# EasyEDA Pro project AgOopenHardwareMicro.eprj, board PCB_AIO v4.5 Micro AMP 2024-02-05 (continued)
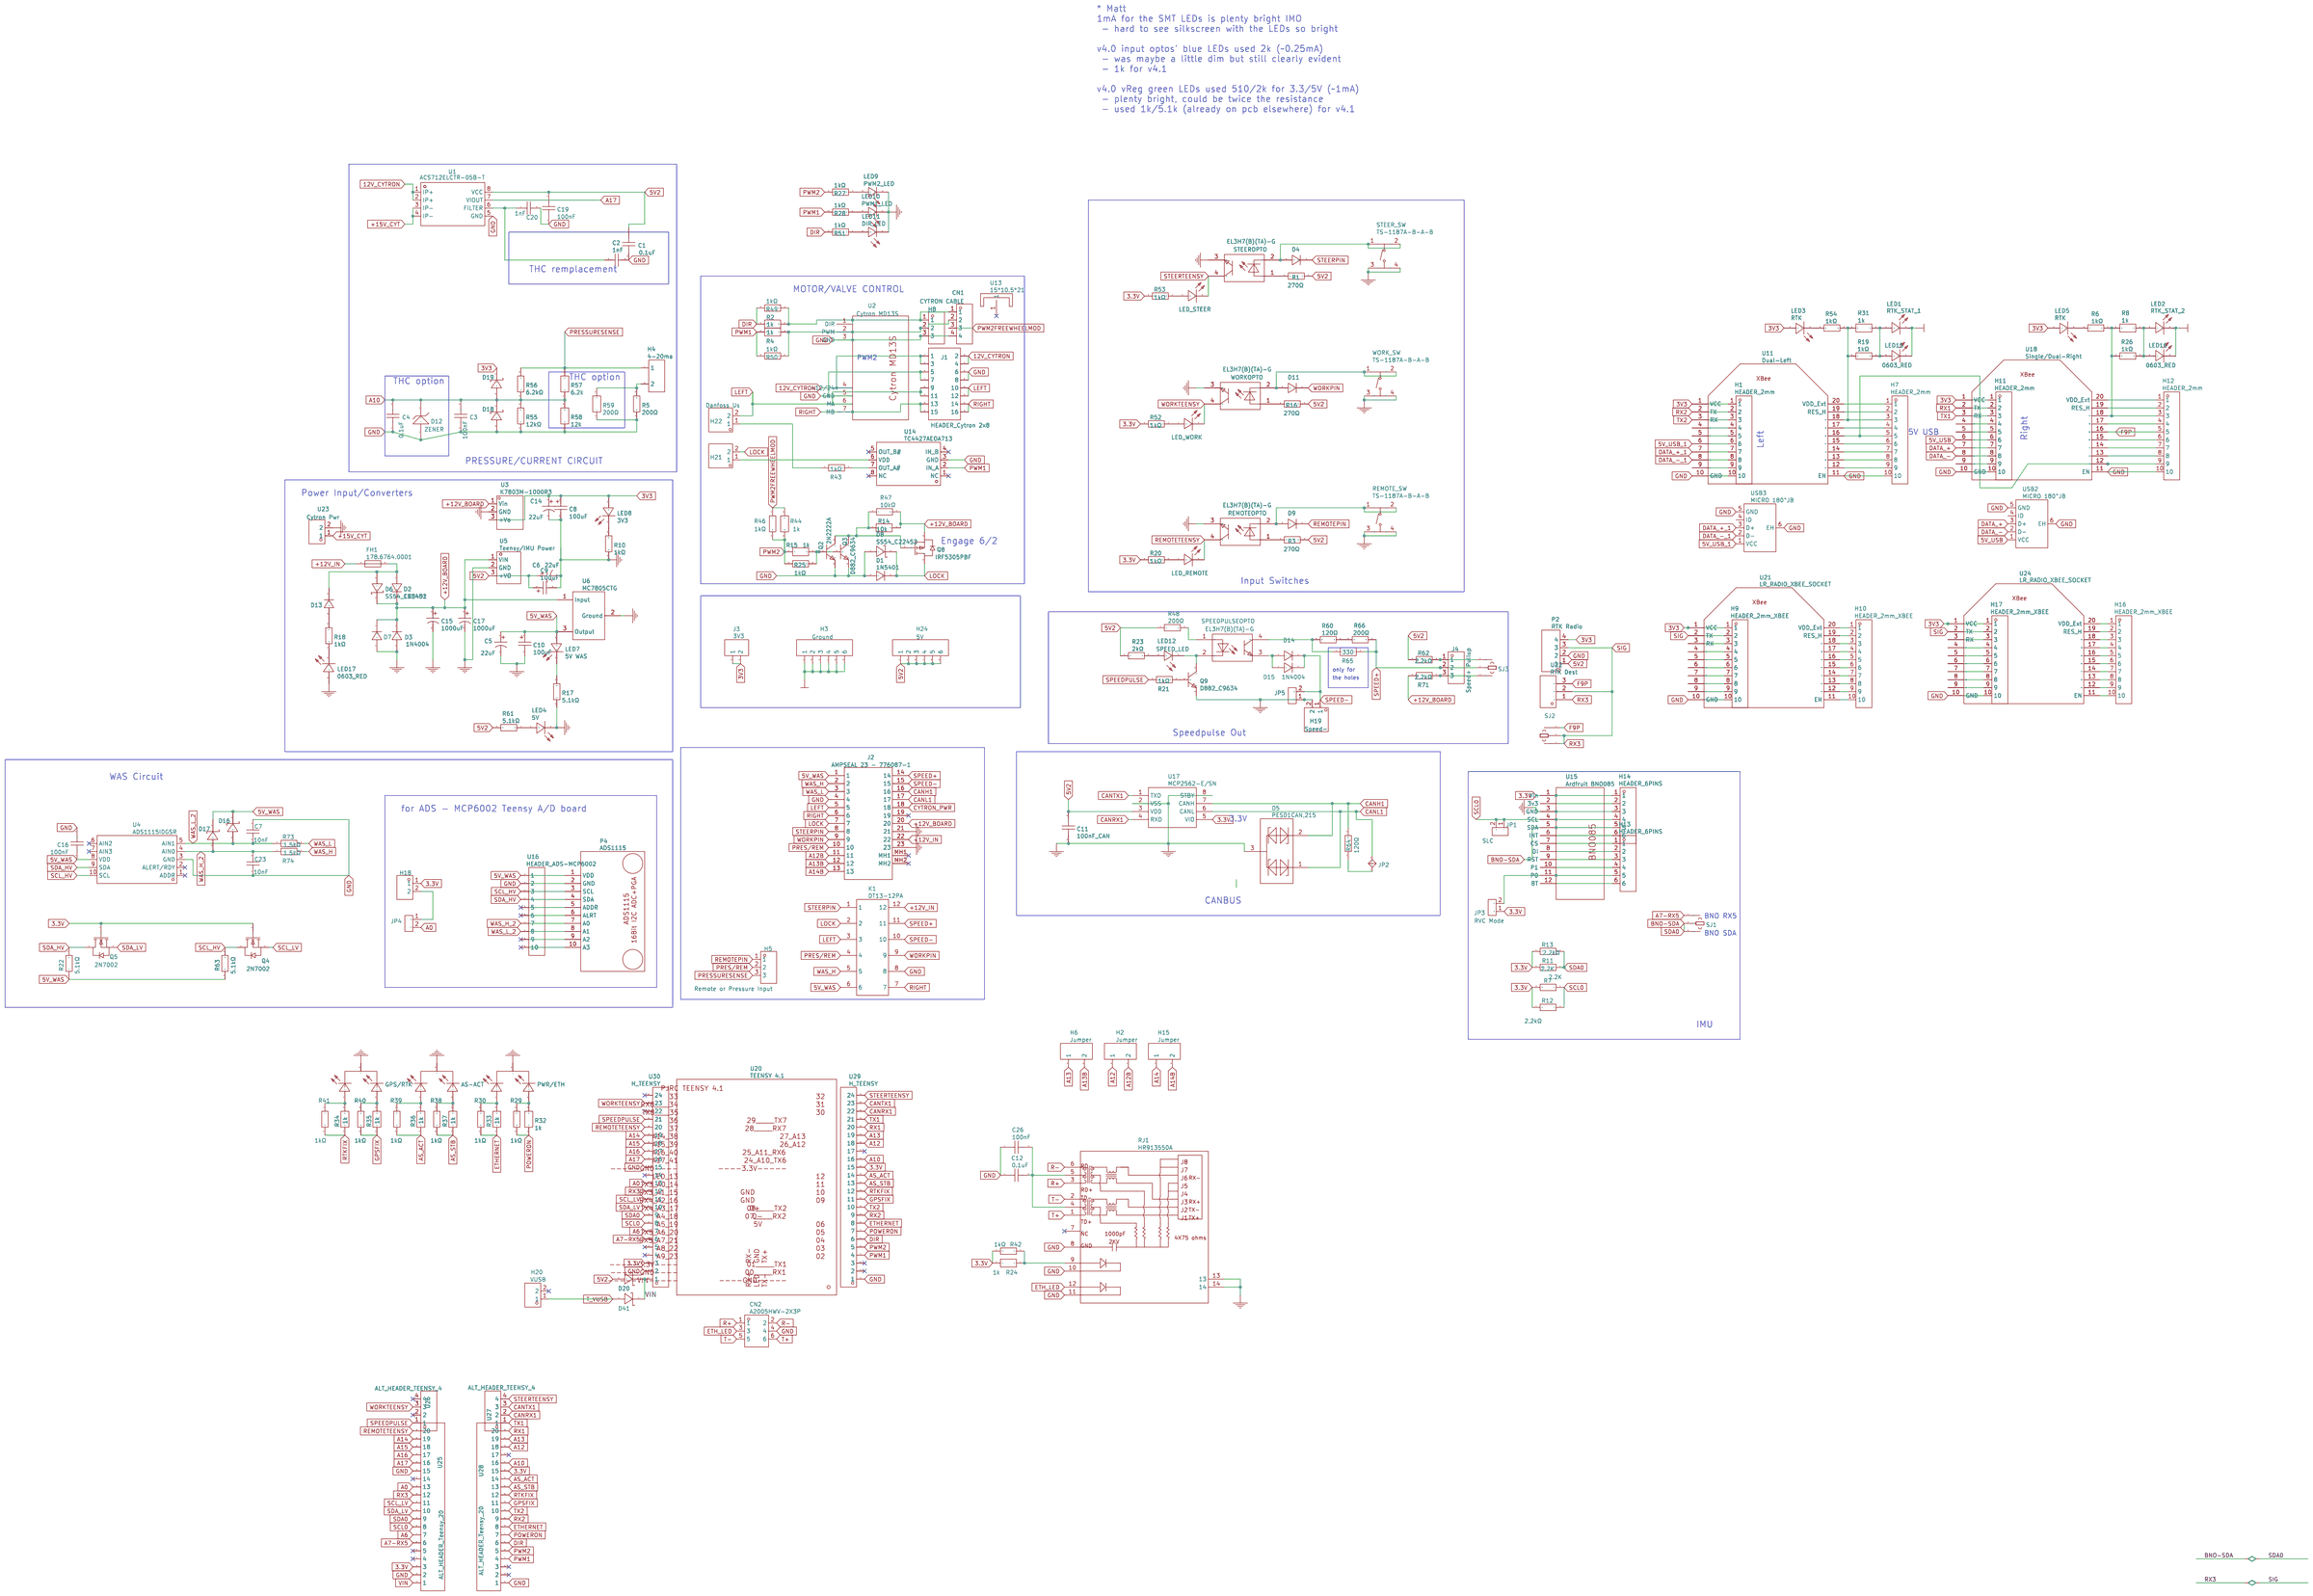
[diagram p0: schematic sheet]
## Footprints (pads in the part's own frame, mm; a bottom-side part is the same pattern mirrored in y, then rotated) (continued)
footprint_c888
  rect 1.8x1.6 hole 1.02: 1(-6.35,0)
  round 1.6 hole 1.02: 2(-3.81,0) 3(-1.27,0) 4(1.27,0) 5(3.81,0) 6(6.35,0)
footprint_cc47
  rect 1.931x1.931 smd: 1(1.27,0) 2(-1.27,0)
footprint_dc35
  rect 1.133x1.377 smd: 1(-0.966,0) 2(0.966,0)
footprint_df55
  rect 1.25x0.7 smd: 1(1,-0.95) 2(1,0.95) 3(-1,0)
footprint_dfc0
  rect 1.8x1.8 hole 1.2: 1(-6.35,0)
  round 1.8 hole 1.2: 2(-3.81,0) 3(-1.27,0) 4(1.27,0) 5(3.81,0) 6(6.35,0)
footprint_e2a5
  rect 1.208x1.701 smd: 1(-1.478,0) 2(1.479,0)
footprint_e36f
  rect 1.931x1.931 smd: 1(1.27,0) 2(-1.27,0) 3(-3.81,0)
footprint_eabb
  round 2 hole 1.5: 1(0,0)
footprint_eaf4
  rect 2.5x2 hole 1.3: 1(0,2.54)
  oval 2.5x2 hole 1.3: 2(0,0) 3(0,-2.54)
footprint_eb8a
  rect 0.806x0.864 smd: 1(-0.753,0) 2(0.753,0)
footprint_eecc
  rect 1x0.8 smd: 1(1.15,-0.95) 2(1.15,0.95) 3(-1.15,0)
footprint_f649
  rect 2.5x2 hole 1.4: 1(0,2.54)
  oval 2.5x2 hole 1.4: 2(0,0) 3(0,-2.54)
Pad_e5261
  round 3 hole 1.75: 10(0,0)
Pad_e5262
  oval 2x2.5 hole 1.1: 3(0,0)
Pad_e5263
  oval 2x2.5 hole 1.1: 2(0,0)
Pad_e5264
  oval 2x2.5 hole 1.082: 1(0,0)
Pad_e5277
  round 3 hole 1.75: 10(0,0)
Pad_e5282
  round 1.6 hole 1: 1(0,0)

## Nets
As in the schematic, except:
3V3: C8.1 C14.1 D19.1 H1.1 H9.1 H11.1 J3.1 J3.2 LED3.1 LED5.1 LED8.1 NOREF#5.3 P2.4 U3.3 U11.1 U18.1 U24.1
5V_WAS: C5.1 C10.1 C16.1 D16.1 D17.1 J2.1 LED7.1 NOREF#4.1 P4.1 R22.1 R63.1 U4.8 U6.3 U16.1
5VUSB: H11.6 U18.6 USB2.1
5VUSB1: H1.6 U11.6 USB3.1
12V_CYTRON: J1.1 J1.2 J1.3 J1.4 U1.1 U1.2 U2.4 U2.8
+12V_BOARD: C15.1 C17.1 D2.1 D3.2 D6.2 D7.1 J2.20 NOREF#6.1 Q8.3 R14.2 R47.2 R71.1 U3.1 U5.1 U6.1
+15VCYT: U1.3 U1.4 U23.1
GND: AS-ACT.2 C1.2 C2.2 C3.1 C4.1 C5.2 C6.2 C7.2 C8.2 C9.2 C10.2 C11.1 C12.1 C14.2 C15.2 C16.2 C17.2 C19.1 C20.2 C23.1 C26.1 CN1.4 CN2.4 D1.2 D3.1 D5.3 D7.2 D8.1 D12.1 D18.2 GPS/RTK.2 H1.10 H3.1 H3.2 H3.3 H3.4 H3.5 H3.6 H7.10 H8.3 H9.10 H11.10 H12.10 H14.3 H19.2 J1.5 J1.6 J1.7 J1.8 J2.4 J2.21 J2.23 JP5.1 LED1.2 LED2.2 LED4.2 LED9.1 LED10.1 LED11.1 LED15.1 LED16.1 LED17.2 NOREF#3.2 P2.2 P4.2 PWR/ETH.2 Q2.3 Q3.3 Q9.3 R5.1 R10.1 R17.1 R55.1 R58.1 R59.1 REMOTE_SW.3 REMOTE_SW.4 REMOTEOPTO.3 RJ1.8 RJ1.10 RJ1.11 RJ1.13 RJ1.14 STEER_SW.3 STEER_SW.4 STEEROPTO.3 U1.5 U2.3 U2.5 U2.9 U3.2 U4.3 U5.2 U6.2 U11.10 U11.11 U14.3 U15.3 U16.2 U17.2 U17.8 U18.10 U18.11 U23.2 U24.10 U29.1 U30.2 U30.15 USB2.5 USB2.6 USB2.7 USB3.5 USB3.6 USB3.7 WORK_SW.3 WORK_SW.4 WORKOPTO.3
CYTRON_PWR: J2.18 NOREF#2.10
D2_2: D2.2 D6.1 D13.1 FH1.2 NOREF.10
DATA+: H11.7 U18.7 USB2.3
DATA+1: H1.7 U11.7 USB3.3
DATA-: H11.8 U18.8 USB2.2
DATA-1: H1.8 U11.8 USB3.2
LEFT: H22.2 J1.9 J1.10 J1.11 J1.12 J2.5 U2.6 U2.11
RIGHT: J1.13 J1.14 J1.15 J1.16 J2.6 U2.7 U2.10

Pads without a net: H1 4 5 9; H7 1 2 4 6 7 8 9; H9 3 4 5 6 7 8 9; H10 1 2 3 4 5 6 7 8 9 10; H11 4 5 9; H12 1 2 4 6 7 8; H20 2; J2 19 MH1 MH2; P4 5 6 9 10 P$1 P$2; RJ1 7; U4 1 2 6 7; U11 4 5 9 12 13 14 15 17 19 20; U13 1; U14 1 4 5 8; U16 5 6 9 10; U18 4 5 9 13 14 15 17 19 20; U24 3 4 5 6 7 8 9 11 12 13 14 15 16 17 18 19 20; U29 2 3 17; U30 4 5 14 22 24; USB2 4; USB3 4

## Via types
v1: diameter 0.8, hole 0.4, Top Layer to Bottom Layer, 4 vias
v2: diameter 2.2, hole 1.4, Top Layer to Bottom Layer, 1 via
v3: diameter 0.61, hole 0.305, Top Layer to Bottom Layer, 91 vias

## Routing (per net, layer and track width the routed paths; a pad name or vN(x,y) marks a point on that pad's centre or on a via; arc(x,y) is an arc through that point)
3.3V: length 323.1
  Top Layer w0.254: JP3.1 83.85,86.73 83.82,86.7 ; 79.25,146.17 H18.1 ; 79.25,146.17 77.41,144.33 76.82,144.33 ; 79.25,146.17 77.15,148.27 Q4.1 ; v3(100.2,127.63) 100.46,127.63 101.35,126.74 ; 101.35,126.74 101.73,126.36 105.54,126.36 106.43,125.47 U17.5 106.43,121.95 104.5,120.03 104.5,116.3 83.82,95.62 83.82,85.08 82.55,83.81 82.55,78.48 ; 101.35,126.74 R20.2 ; 82.55,78.35 82.55,72.13 81.41,70.99 81.41,69.63 R7.2 R12.1 ; 90.35,59.56 R11.2 ; R53.2 v3(100.2,137.8) ; v3(101.35,144.77) 101.35,147.45 ; R24.2 19.81,66.42
  Inner1 w0.254: v3(101.35,144.77) 100.2,143.63 v3(100.2,127.63) ; R7.2 84.33,69.59 89.41,64.51 H14.1
  Inner1 w0.3: 88.01,59.56 90.04,57.52 90.04,51.17 91.19,50.67 91.19,47.45 93.77,44.86 93.73,33.52 93.09,32.89 83.31,32.89 82.3,33.9 U29.15 ; 88.01,59.56 R11.2 ; 88.01,59.56 88.01,60.44 89.41,61.84 H14.1
  Inner2 w0.254: U29.15 82.3,36.57 80.01,38.85 58.42,38.85 55.25,42.03 55.25,46.35 51.94,49.65 U30.3 ; v3(101.35,144.77) 100.46,145.66 81.91,145.66 H18.1
  Bottom Layer w0.254: R24.2 21.34,61.33 32.64,50.43 32.64,44.59 33.27,43.57 42.52,43.56 43.94,42.41 51.82,42.41 53.34,40.9 75.27,40.94 82.17,34.05
3V3: length 353.9
  Top Layer w0.254: 25.63,86.86 25.37,87.11 LED8.1 ; J3.2 J3.1 96.77,91.94 102.62,86.1 105.66,86.1 108.71,83.05 108.71,21.84 P2.4 ; LED5.1 33.78,26.16 34.29,25.65 34.29,21.58 ; D19.1 85.19,107.43 v3(86.23,107.43) ; 32.01,54.41 32.39,54.03 32.39,51.68 LED3.1
  Top Layer w1: C14.1 25.63,91.14 25.63,86.86
  Top Layer w1.5: 8.78,6.6 8.78,8.39 21.97,21.58 64.77,21.58 80.21,6.14 U24.1 ; 25.6,81.78 25.63,81.81 25.63,86.86 ; 10.67,36.06 8.78,34.17 U11.1
  Top Layer w2: 25.63,81.81 22.8,78.99 22.73,78.99 22.73,62.86 34.16,52.44 34.29,47.11 32.51,45.46 20.07,45.46 10.67,36.06 ; NOREF#5.3 28.63,81.78 25.65,81.78
  Inner1 w0.254: U11.1 8.78,32.38 ; 8.78,6.6 U18.1
  Inner1 w1.5: 8.78,6.6 8.78,8.61 6.35,11.04 6.35,30.85 7.87,32.38 8.78,32.38
  Inner2 w0.254: v3(86.23,107.43) 95.5,98.16 J3.2
  Bottom Layer w0.254: U24.1 79.33,6.14
  Bottom Layer w1.5: P2.4 90.93,19.55 84.09,12.71 U24.1
5V2: length 443.4
  Top Layer w0.25: 64.45,105.62 52.64,105.7
  Top Layer w0.254: 108.97,135.51 108.97,144.91 108.2,145.68 R16.2 ; 108.97,135.51 R3.2 ; 108.97,135.51 108.97,121.28
  Top Layer w0.3: 53.72,70.75 52.2,69.22 v1(52.2,61.84)
  Top Layer w0.6: 53.97,107.31 53.28,106.69 52.9,106.32 ; H24.1 H24.3 H24.5 101.6,92.07 103.5,90.16 v1(108.97,90.16) 108.97,115.12 ; v1(54.86,125.34) U1.8 ; 108.97,115.12 C11.2 ; 108.97,115.12 108.97,121.28 106.68,121.28 105.16,119.75 U17.3 ; R23.1 42.95,99.31 C1.1 43.45,99.33 45.72,101.59 51.69,101.59 52.58,102.48 52.58,105.99 52.9,106.32 ; D20.2 v1(43.31,53.46)
  Top Layer w1: 45.59,143.5 45.59,145.41 46.65,146.47 C9.1 ; C6.1 45.48,154.03 46.65,152.85 46.65,147.82
  Inner1 w0.6: 45.59,143.5 45.59,137.03 54.86,127.75 v1(54.86,125.34) ; P2.1 108.97,14.47 v1(108.97,90.16)
  Inner1 w1: v1(43.31,53.46) 46.74,55.31 46.74,67.41 40.51,73.27 40.51,76.19 41.28,76.95 41.28,87.5 37.21,87.5 37.21,97.27 41.8,99.33 C1.1 41.89,99.33 38.1,103.12 38.1,136.01 45.59,143.5
  Inner2 w0.3: v1(52.2,61.84) 46.74,56.38 v1(43.31,53.46)
  Bottom Layer w0.6: v1(108.97,90.16) 108.95,90.18 74.8,90.18 71.12,92.83 59.06,92.83 52.71,99.18 42.98,99.38 C1.1
5V_WAS: length 117.6
  Top Layer w0.254: C16.1 74.93,125.91 U4.8 ; U6.3 54.99,147.31 LED7.1 ; R63.1 67.95,153.65 P4.1 ; R22.1 73.01,140.71
  Top Layer w0.3: 74.93,124.24 74.93,122.93 ; 74.93,122.93 78.14,122.93 78.53,123.31 78.53,121.02 ; 74.93,122.93 73.66,122.93
  Top Layer w0.6: NOREF#4.1 73.01,142.1 73.01,123.61 73.66,122.93
  Top Layer w1: 61.06,151.38 61.06,153.78 C5.1
  Inner2 w0.6: NOREF#4.1 73.03,148.58 P4.1 67.68,153.93 C5.1 ; U6.3 51.44,149.98 34.29,149.98 23.5,139.18 J2.1
  Bottom Layer w1: U6.3 56.25,148.96 C5.1
5VUSB: length 13.5
  Top Layer w0.6: 31,7.58 30.51,7.58 29.84,8.25 19.94,8.25 18.78,7.09 18.78,6.6
5VUSB1: length 12.9
  Inner1 w0.6: USB3.1 30.38,33.36 29.72,34.03 20.43,34.03 18.78,32.38
12V_CYTRON: length 16.1
  Top Layer w1.75: U2.8 U2.4
  Top Layer w4: 62.74,125.09 62.74,114.04
  Bottom Layer w1.75: U2.8 U2.4
+12V_BOARD: length 284.2
  Top Layer w0.25: 31.75,79.77 46.38,79.77 59.69,93.46 R71.1 57.76,103.4
  Top Layer w0.4: R47.2 57.76,103.4
  Top Layer w1.5: D3.2 34.67,117.62 D7.1
  Top Layer w2: 8.8,123.18 6.99,123.18 5.33,121.53 5.33,96.51 7.24,94.61 32,94.61 32,78.99 29.72,76.7 NOREF#6.1
  Top Layer w3: 40,139.11 39.94,139.18 C17.1 ; D6.2 D2.1 36.83,130.11 36.83,130.93 40,134.1 40,148.96 C15.1
  Inner1 w1.5: U6.1 51.55,154.04 50.67,153.17 U5.1
  Bottom Layer w1.5: D2.1 31.75,123.09 D3.2 37.2,122.7 44.94,122.7 46.74,120.89 46.74,119.37 ; U6.1 51.55,154.04 48.25,150.74 38.23,150.74 C15.1
  Bottom Layer w2.5: C15.1 33.66,149.98 9.27,149.98 5.33,146.04 5.33,124.83 6.98,123.18 J2.20
+12V_IN: length 28
  Bottom Layer w3: FH1.1 10.67,98.42 5.46,103.62 5.46,113.78 6.86,115.18 J2.22
+15VCYT: length 10.9
  Top Layer w4: 62.74,129.41 62.74,138.93 U23.1
GND: length 1175.3
  Top Layer w0.254: R58.1 83.31,108.52 D18.2 82.89,106.79 R55.1 ; U14.3 65.53,85.46 v3(66.04,85.97) ; v3(30.61,98.67) 30.74,98.54 LED17.2 ; v3(74.29,105.53) 74.79,105.04 76.45,105.04 R59.1 76,99.62 73.03,96.64 73.03,96.15 C4.1 78.51,93.87 80.58,95.94 C3.1 ; 26.78,28.69 26.78,32.38 ; J1.7 J1.5 U2.5 ; 99.19,128.64 99.19,129.97 98.68,130.48 REMOTE_SW.3 ; 99.19,128.64 99.44,128.39 102.74,128.39 103.43,129.07 REMOTEOPTO.3 103.76,127.63 104.14,127.25 106.93,127.25 106.93,131.56 104.39,134.1 104.39,137.28 ; 99.19,128.64 98.68,128.14 98.68,127.88 102.07,124.49 U17.8 103.25,125.13 103.25,125.88 105.34,125.88 105.79,125.43 105.79,122.04 103.89,120.13 U17.2 103.89,117.9 102.62,116.63 100.99,116.63 97.4,120.22 D5.3 v3(97.41,118.86) ; C20.2 49.46,133.99 50.38,134.91 ; U30.2 46.1,52.83 46.1,58.98 45.03,58.98 ; P4.2 67.69,151.38 64.67,151.38 64.67,147.22 64.25,146.8 ; C12.1 26.37,66.6 C26.1 ; v3(75.44,122.04) 77.09,122.04 v3(77.22,121.91) v3(77.22,120.13) ; v3(18.92,86.35) 19.05,86.48 19.05,91.04 R10.1 21.34,91.43 v3(22.22,91.43) 23.62,92.83 28.58,92.83 v3(29.08,92.32) ; 85.87,123.31 v3(85.85,125.09) ; v3(92.07,129.02) 92.08,130.48 ; 56.51,130.55 v3(55.25,130.55) v3(54.36,131.44) ; 33.78,65.96 D1.2 40.46,61.9 43.28,59.07 45,59.07 ; STEER_SW.3 98.68,140.13 98.68,138.68 98.81,138.55 103.59,138.55 STEEROPTO.3 103.76,137.28 105.79,137.28 106.3,137.79 106.3,140.45 104.39,142.36 104.39,146.8 103.76,147.44 WORKOPTO.3 103.76,148.2 100.33,148.2 98.75,149.78 98.68,149.78 ; C23.1 C7.2 85.87,119.01 v3(85.34,118.48) ; 74.93,120.18 74.93,121.41 75.41,121.89 ; 30.96,31.09 31.5,31.62 v3(31.5,32.38) ; LED15.1 31.11,49.11 v3(31.11,47.74) ; U29.1 46.74,33.39 53.38,26.75 LED11.1 ; U2.9 55.12,112.51 55.12,109.6 54.3,108.77 49.6,108.77 42.93,102.1 C1.2 ; Q9.3 47.79,83.47 v3(48.26,83.94) ; v3(75.56,129.53) 75.69,129.41 C16.2 ; 50.38,147.82 50.16,147.82 50.16,154.42 49.78,154.81 C6.2 46.98,156.33 42.54,156.33 42.54,147.66 LED4.2 ; v3(32.77,22.98) 31.62,24.13 31.41,24.13 ; v3(42.67,81.53) 43.05,81.15 45.34,81.15 46.71,82.52 46.71,83.73 ; 57.37,129.7 U1.5 57.37,129.82 52.45,134.74 50.55,134.74 48.13,137.15 U5.2 ; D3.1 34.29,111.85 D7.2 ; H3.1 106.87,105.97 v3(106.87,113.28) C11.1 ; v3(52.07,108.07) 52.77,108.77 C19.1 ; WORK_SW.3 98.68,149.78 ; v3(27.81,86.1) 28.58,86.86 29.24,86.86 29.24,89.11 C14.2 27.17,92.83
  Top Layer w0.4: C20.2 C2.2
  Inner1 w0.254: 1.61,61.44 3.05,60.01 3.05,56.13 LED1.2 3.55,54.36 3.55,30.72 LED2.2 ; 30.74,35.96 30.74,38.02 USB3.6 ; U3.2 24.42,79.24 ; 24.42,79.24 26.8,81.62 26.8,90.81 C14.2 ; 24.42,79.24 24.77,78.48 24.77,74.03 24.26,71.42 24.26,68.72 C12.1 ; J2.23 8.13,111.18 8.13,95.43 PWR/ETH.2 1.96,89.26 1.96,83.74 ; C17.2 36,133.54 36,112.79 D3.1 ; AS-ACT.2 1.96,78.23 1.96,83.74 ; v3(42.67,81.53) Q2.3 ; RJ1.11 1.61,69.36 1.36,69.61 ; v3(29.08,92.32) 29.08,97.15 v3(30.61,98.67) ; v3(74.29,105.53) 75.56,106.8 80.01,106.8 81.91,108.7 R58.1 ; 31.22,12.46 31,12.24 31,11.79 ; 31,24.94 32.46,24.94 v3(32.77,24.63) ; U23.2 50.55,140.33 48.13,142.74 U5.2 46.98,144.66 C6.2 ; v3(75.56,129.53) 75.44,129.41 v3(75.44,122.04) ; C1.2 44.45,100.3 v3(44.45,92.19) ; 1.96,83.74 GPS/RTK.2 ; 31,11.79 31,31.05 30.96,31.09 ; 31,11.79 USB2.5 ; P4.2 70.63,148.44 v3(70.63,143.5) ; CN2.4 61.71,45.25 ; v3(32.77,22.98) 31,22.98 ; v3(31.11,47.74) v3(29.21,47.74) 27.31,47.74 24.77,50.28 24.77,51.55 26.78,53.57 U11.11 ; H7.10 26.78,54.48
  Inner2 w0.254: C12.1 25.53,55.68 H7.10 30.96,50.24 USB3.6 ; v3(66.04,83.3) v3(66.04,85.97) ; v3(66.04,85.97) 65.28,85.21 v3(61.34,85.21) 61.47,85.34 v3(61.47,86.86) ; v3(66.04,85.97) 67.42,85.97 C4.1 ; J2.23 10.8,113.18 10.8,119.18 ; U30.2 51.9,52.27 53.17,52.27 U2.3 ; v3(77.22,120.13) 81.66,120.13 v3(84.58,117.21) ; v3(85.85,125.09) 88.14,125.09 v3(92.07,129.02) ; v3(84.58,117.21) 84.58,110.22 D12.1 81.99,109.84 R58.1 ; v3(84.58,117.21) 84.58,117.72 v3(85.34,118.48) ; 10.8,119.18 10.8,130.17 11.81,131.18 13.84,131.18 16.8,128.23 J2.4 ; 10.8,119.18 J2.21 ; U24.10 102.1,6.99 82.68,26.41 82.68,29.46 83.95,30.73 87.38,30.73 88.65,32 88.65,35.55 82.3,41.9 U30.15 82.3,48.63 86.36,44.57 104.78,44.57 107.31,47.11 107.31,54.73 102.87,59.17 98.81,59.17 H14.3 ; U2.3 56.51,54.6 56.51,53.46 58.42,51.55 62.87,51.55 63.25,51.17 63.25,45.51 63.5,45.26 CN2.4 ; U2.3 56.01,57.27 54.36,57.27 CN1.4 ; v3(31.11,47.74) 33.02,49.65 v3(38.74,49.65) v3(41.28,47.11) ; v3(106.87,113.28) 103.07,117.07 v3(100.54,117.07)
  Bottom Layer w0.254: U29.1 44.7,36.44 30.74,36.44 30.74,35.96 27.2,32.43 U11.10 ; 43.84,86.48 45.72,86.48 v3(48.26,83.94) ; 43.84,86.48 29.64,92.55 v3(29.08,92.32) ; 43.84,86.48 42.42,86.48 v3(42.67,81.53) ; 43.84,86.48 43.84,91.58 v3(44.45,92.19) ; CN2.4 79.57,45.26 82.3,47.98 U30.15 ; RJ1.14 9.01,57.77 6.73,55.49 LED1.2 ; U5.2 48.13,145.79 ; 48.13,145.79 38.1,145.79 C15.2 ; 48.13,145.79 51.94,151.25 U6.2 55.63,151.5 59.55,155.43 C5.2 65.39,151.25 P4.2 ; U24.10 102.1,10.27 106.3,14.47 P2.2 ; AS-ACT.2 5.03,75.16 5.03,73.27 ; v3(75.56,129.53) 75.56,130.42 v3(76.58,131.44) 70.63,137.39 v3(70.63,143.5) ; USB3.7 29.67,32.38 26.78,32.38 ; 29.93,6.6 26.78,6.6 ; 29.93,6.6 USB2.7 ; 29.93,6.6 29.93,9.11 USB2.5 ; 5.03,73.27 RJ1.13 ; 5.03,73.27 1.61,69.86 RJ1.10 ; H19.2 JP5.1 53.34,100.45 52.71,101.08 52.71,105.53 52.07,106.16 v3(52.07,108.07) ; H3.1 106.04,92.45 ; v3(43.56,104.26) 42.29,104.26 ; 9.31,57.77 13.21,57.78 RJ1.8 16.35,60.14 21.06,60.14 H7.10 ; v3(97.41,118.86) 94.96,116.42 87.21,116.42 81.99,111.2 60.2,111.24 58.55,112.9 U2.5 U2.9 ; D1.2 31.08,61.9 C12.1 ; 34.67,111.47 37.88,111.47 42.29,107.05 v3(42.29,103.5) 42.29,102.46 C1.2
VIN: length 6
  Top Layer w0.584: D41.1 43.79,48.38 D20.1 44.45,48.86 45.24,49.65 U30.1
A0: length 4.3
  Top Layer w0.254: U30.13 77.22,45.33
A7-RX5: length 50.4
  Top Layer w0.254: U30.6 60.71,48.38 67.94,48.38 68.33,48.76 68.33,50.67 69.09,51.43 69.72,51.43 76.45,58.16 94.23,58.16 95,57.4 101.22,57.4 102.04,58.22 SJ1.1
A10: length 91.7
  Top Layer w0.254: R56.1 R55.2 81.95,104.86 D18.1 D19.2 D12.2 81.91,99.62 ; C4.2 77.07,96.37 77.98,97.27 C3.2 79.18,99.55 R57.1 R58.2
  Inner1 w0.254: U29.16 75.95,43.3 75.95,52.82 73.41,55.36 73.41,95.75 74.02,96.37 C4.2
A12: length 20.6
  Inner1 w0.254: H2.1 86.11,51.81 86.11,39.24 89.66,35.68 89.66,34.66 U29.18
A12B: length 143.4
  Inner1 w0.254: v3(19.81,82.29) 19.81,91.99 19.05,92.75 19.05,102.99 10.8,111.24 10.8,127.18 J2.11
  Bottom Layer w0.254: H2.2 77.34,55.49 75.18,57.65 75.18,75.18 74.29,76.07 37.59,76.19 35.03,73.65 30.1,73.65 29.21,74.54 21.84,74.54 19.81,76.57 v3(19.81,82.29)
A13: length 20.4
  Inner1 w0.254: U29.19 88.65,38.22 88.65,52.95 H6.1
A13B: length 128.9
  Inner1 w0.254: J2.12 14.61,123.38 14.61,110.61 18.42,106.8 33.02,106.8 v3(35.31,104.51)
  Inner2 w0.254: v3(35.31,104.51) 35.31,101.34 39.37,97.27 51.44,97.27 v3(52.83,95.88)
  Bottom Layer w0.254: H6.2 86.74,57.14 77.6,57.14 75.95,58.79 75.95,84.6 69.77,90.77 57.94,90.77 v3(52.83,95.88)
A14: length 3.5
  Inner1 w0.254: U30.19 92.46,52.44 H15.1
A14B: length 130.6
  Bottom Layer w0.254: H15.2 89.53,57.9 78.74,57.9 76.71,59.94 76.71,84.96 70.23,91.43 58.42,91.43 51.94,97.91 29.84,97.91 27.94,96 24.38,96 23.11,97.27 23.11,102.1 14.61,110.61 14.61,119.38 J2.13
A17: length 105.8
  Top Layer w0.254: v3(59.44,126.61) U1.7
  Inner1 w0.254: v3(59.44,126.61) 66.17,119.88 66.17,109.97 59.69,104.26 59.69,93.46 59.82,92.19 59.82,70.35 63.5,67.18 63.5,61.84 64.52,60.83 v3(64.52,52.06)
  Inner2 w0.254: U30.16 82.42,52.06 v3(64.52,52.06)
AS-ACT_1: length 8.9
  Top Layer w0.254: 11.22,76.45 R36.2
  Inner2 w0.254: AS-ACT.1 5.45,74.73 R36.2
AS-ACT_3: length 8.3
  Top Layer w0.254: 11.22,79.11 R37.2
  Bottom Layer w0.254: AS-ACT.3 6.85,79.43 R37.2
AS_ACT: length 98.9
  Top Layer w0.254: R36.1 12.82,76.45
  Inner1 w0.254: v3(51.31,41.78) 51.31,45.33 50.55,45.97 50.55,50.92 48.51,52.95 48.51,68.57 v3(47.12,69.97)
  Bottom Layer w0.254: U29.14 79.76,35.17 74.8,40.12 52.96,40.12 v3(51.31,41.78) ; 17.66,76.23 21.21,72.69 44.38,72.69 47.31,69.76
AS_STB: length 95.6
  Top Layer w0.254: R37.1 R38.2
  Inner1 w0.254: v3(28.32,73.53) 28.32,58.95 34.54,52.72 34.54,48 v3(42.8,39.74)
  Bottom Layer w0.254: v3(28.32,73.53) 21.59,73.53 18.87,76.25 18.87,77.71 R37.1 ; U29.13 77.22,35.04 73.91,38.35 44.2,38.35 v3(42.8,39.74)
BNO-SDA: length 50.6
  Top Layer w0.254: U30.9 67.31,49.9 67.31,51.05 68.71,52.44 69.6,52.44 77.85,60.7 86.74,60.7 86.87,60.83 91.82,60.83 92.28,60.37 92.28,59.56 ; R13.2 R11.1 94.59,59.62 SJ1.3 SJ1.2 ; 99.5,63.43 SJ1.2 ; 99.5,63.43 H14.5 ; 99.5,63.43 H14.5 ; 99.5,63.43 H14.5 ; 99.5,63.43 H14.5 ; 99.5,63.43 SJ1.2 ; 99.5,63.43 SJ1.2
C2_1: length 9.1
  Top Layer w0.4: U1.6 56.26,127.88 52.71,131.44 C2.1 C20.1
CANH1: length 132.3
  Top Layer w0.254: 99.7,123.95 D5.2 ; 99.7,123.95 98.2,123.95 97.7,124.45 R64.2 ; 99.7,123.95 100.27,123.95 v3(100.78,124.45) ; U17.7 103.89,123.82 103,122.93 102.31,122.93 100.78,124.45
  Inner1 w0.254: v3(69.85,127.12) 68.07,127.12 64.9,130.29 64.9,144.39 55.64,153.66 55.64,155.26 55.09,155.82 42.67,155.82 37.47,150.61 22.86,150.61 11.43,139.18 J2.16
  Bottom Layer w0.254: v3(69.85,127.12) 98.12,127.12 100.78,124.45
CANL1: length 119.6
  Top Layer w0.254: v3(77.22,129.15) 78.1,128.26 89.03,128.26 91.44,125.85 91.44,118.61 92.07,117.98 93.85,117.98 94.56,118.69 JP2.2 94.56,121.91 98.17,121.91 99.02,120.62 99.7,120.62 99.7,119.95 101.28,119.95 105.16,123.82 U17.6
  Inner2 w0.254: v3(77.22,129.15) 74.17,132.2 66.23,132.2 61.15,137.28 33.2,137.28 32.56,137.91 19.69,137.91 19.05,137.28 15.88,137.28 13.72,139.44 12.06,139.44 8.76,136.14 8.76,135.18 J2.17
CANRX1: length 95.1
  Top Layer w0.254: v3(106.11,117.64) 106.11,118.76 U17.4
  Inner1 w0.254: U29.22 101.36,33.12 106.28,33.12 107.06,33.9 107.06,50.28 108.08,51.81 108.08,82.02 107.95,108.58 105.41,110.48 105.33,116.86 106.11,117.64
CANTX1: length 94
  Top Layer w0.254: v3(103.63,120.9) 102.62,119.88 U17.1
  Inner1 w0.254: v3(103.63,120.9) 103.73,120.8 103.76,114.04 99.82,112.13 99.57,85.34 103.73,82.47 103.76,82.44 v3(103.76,52.7)
  Bottom Layer w0.254: U29.23 103.89,35.68 103.89,52.57 v3(103.76,52.7)
CYTRON_PWR: length 42.8
  Top Layer w3.5: NOREF#2.10 10.16,154.42 5.33,149.6 5.33,133.09 7.24,131.18 J2.18
D2_2: length 34.8
  Top Layer w0.254: NOREF.10 26.19,103.65 40,103.65 40,102.63
  Top Layer w3: D6.1 D2.2
  Bottom Layer w3: FH1.2 25.78,98.99 NOREF.10 25.78,105.46 D2.2
D4_2: length 17.1
  Top Layer w0.254: STEEROPTO.2 103.76,144.97 102.62,143.83 STEER_SW.1 92.08,145.69 90.07,147.69
D9_2: length 17.2
  Top Layer w0.254: REMOTEOPTO.2 100.08,135.58 98.68,134.18 REMOTE_SW.1 92.08,136.29 90.07,138.3
D11_2: length 15.4
  Top Layer w0.254: 90.07,155.82 92.08,153.81 WORK_SW.1 98.68,153.48 100.08,154.89 WORKOPTO.2
D13_2: length 3.7
  Top Layer w0.254: D13.2 40,98.52 37.36,98.52 37.33,98.54
D15_1: length 13.7
  Top Layer w0.254: 47.4,96.77 48.29,96.77 50.07,94.99 45.72,94.99 41.78,91.05 41.4,91.05
DATA+: length 11.1
  Inner2 w0.254: USB2.3 23.02,8.88 U18.7
DATA+1: length 10.9
  Top Layer w0.254: U11.7 23.02,34.66 USB3.3
DATA-: length 14.5
  Bottom Layer w0.254: 32,8.23 32.64,7.59 32.64,4.95 32.13,4.44 24.94,4.44 22.78,6.6
DATA-1: length 14.5
  Bottom Layer w0.254: 31.74,34.01 32.39,33.36 32.39,30.82 31.79,30.22 29.97,30.22 28.96,31.23 23.37,31.23 22.78,31.82 22.78,32.38
DIR: length 55.3
  Top Layer w0.254: R49.2 R2.1 ; U29.6 R51.2
  Inner1 w0.254: R2.1 66.8,71.69 66.8,62.1 65.41,60.7 65.41,53.33 65.79,52.95 65.79,33.95 65.03,33.19 60.66,33.19 U29.6
ETH_LED: length 74.7
  Inner1 w0.254: CN2.3 56.95,45.26 53.97,42.28 v3(53.97,41.9)
  Bottom Layer w0.254: v3(53.97,41.9) 52.96,42.92 44.2,42.92 42.67,44.19 34.04,44.19 33.4,44.95 33.4,50.54 20.7,62.86 19.05,62.86 18.67,62.48 14.35,62.48 14.1,61.97 13.84,61.33 13.33,60.95 11.18,60.95 9.53,62.6 5.59,62.6 1.61,58.9
ETHERNET: length 94.4
  Top Layer w0.254: 17.46,88.38 12.31,88.38
  Inner1 w0.254: U29.8 59.82,38.85 55.12,38.85 53.09,40.63 53.09,51.98 51.21,53.86 51.21,76.67 v3(48.01,79.88)
  Bottom Layer w0.254: 17.46,88.38 18.47,87.37 33.01,87.37 40.5,79.88 v3(48.01,79.88)
F9P: length 34.7
  Top Layer w0.254: v3(37.08,11.04) SJ2.3
  Inner2 w0.254: v3(37.08,11.04) 34.16,13.96 27.56,13.96 16.78,24.74 U18.16
GPS/RTK_1: length 8.6
  Top Layer w0.254: 11.22,82.42 R34.2
  Bottom Layer w0.254: GPS/RTK.1 6.02,81.34 R34.2
GPS/RTK_3: length 8.6
  Top Layer w0.254: 11.22,85.08 R35.2
  Bottom Layer w0.254: GPS/RTK.3 6.15,86.03 R35.2
GPSFIX: length 115.1
  Top Layer w0.254: 17.4,85.08 R40.2
  Inner1 w0.254: v3(35.56,83.18) 35.56,49.14 v3(42.04,42.66)
  Bottom Layer w0.254: U29.11 73.53,33.01 77.85,33.01 78.49,33.65 78.49,35.17 74.42,39.24 45.47,39.24 v3(42.04,42.66) ; v3(35.56,83.18) 32.51,83.18 30.61,85.08 R35.1
H4_2: length 6.8
  Top Layer w0.254: 76.45,107.04 R59.2 75.69,110.68 H4.2
H22_1: length 31.9
  Top Layer w0.6: H22.1 67.18,107.69 70.61,104.26 70.61,90.54 68.91,88.84 68.45,88.13 R43.1
J4_1: length 14.6
  Top Layer w0.254: 66.37,105.66 67.18,105.66 68.45,104.39 68.45,98.42 67.31,97.27 65.41,97.27
  Bottom Layer w0.254: 65.41,97.27 SJ3.1
J4_3: length 6.8
  Top Layer w0.254: J4.3 64.39,103.37 61.54,103.37
  Bottom Layer w0.254: J4.3 SJ3.3
JP4_1: length 112.2
  Top Layer w0.254: JP4.1 78.23,42.92 79.5,41.65 81.03,43.17 v3(81.03,54.22)
  Inner1 w0.254: H18.2 81.41,138.68 88.01,132.07 88.01,96.26 79.63,87.88 79.63,55.62 v3(81.03,54.22)
LED2_1: length 30.6
  Top Layer w0.254: 29.63,24.12 16.89,24.12 15.49,22.73 9.14,22.73 8.89,22.98 R26.1 4.57,24.63 LED2.1
LED9_2: length 1.6
  Top Layer w0.254: 56.9,29.97 56.89,28.35
LED10_2: length 1.6
  Top Layer w0.254: 54.36,29.97 54.35,28.35
LED11_2: length 1.6
  Top Layer w0.254: 59.44,29.97 59.43,28.35
LED12_1: length 19.2
  Top Layer w0.254: 45.21,89.78 46.48,91.05 SPEEDPULSEOPTO.2 ; 45.21,89.78 42.29,86.86 42.29,84.83 40.26,82.8 37.94,82.8 37.34,83.39 ; 45.21,89.78 45.21,86.18
LED12_2: length 29.4
  Top Layer w0.254: 37.34,84.99 37.34,84.83 38.86,83.3 39.75,83.3 41.66,85.21 41.66,87.5 47.75,93.59 51.18,93.59 51.69,94.1 51.69,98.54 50.93,99.31 48,99.31
LED17_1: length 2.1
  Top Layer w0.254: LED17.1 R18.1
LED_REMOTE_1: length 2.3
  Top Layer w0.254: LED_REMOTE.1 R20.1
LED_STEER_1: length 1.6
  Top Layer w0.254: 101.35,140.92 R53.1
LED_WORK_1: length 1.8
  Top Layer w0.254: LED_WORK.1 R52.1
LEFT: length 59.2
  Bottom Layer w1.5: 57.53,107.69 53.47,111.75 53.47,113.4
  Bottom Layer w2: U2.6 53.47,113.4
  Bottom Layer w3.5: J2.5 19.89,123.18 26.24,129.53
  Bottom Layer w4: 52.22,114.69 52.2,123.82 45.37,129.53 26.24,129.53
LOCK: length 123.6
  Top Layer w1.5: H21.2 51.56,78.22 36.67,78.32 33.82,75.46 ; 33.78,70.68 D1.1
  Inner1 w1.5: v2(33.78,101.08) D1.1
  Inner2 w1.5: v2(33.78,101.08) 33.78,104.77 26.16,112.38 26.16,115.18
  Inner2 w1.778: Q8.2 44.2,119.89
  Inner2 w2.286: Q8.2 44.2,121.28 43.81,122.55 33.4,122.67 28.83,118.1 28.83,117.85 26.16,115.18 26.67,115.69 29.21,115.69 30.48,116.96 43.18,116.96 44.2,117.98 Q8.2
  Inner2 w3.429: 16.8,115.18 19.56,115.18
  Inner2 w5.08: 26.16,115.18 19.56,115.18
POWERON: length 95.4
  Top Layer w0.254: R32.1 12.31,91.05
  Inner1 w0.254: v3(35.94,86.48) 38.23,84.19 38.23,52.44 55.63,35.04 55.63,33.65 56.17,33.1 57.62,33.1 58.17,33.65 58.17,34.84 59.09,35.76 60.63,35.76 U29.7
  Bottom Layer w0.254: R32.1 20.01,88.51 33.91,88.51 v3(35.94,86.48)
PRES/REM: length 63.1
  Inner2 w0.254: 12.8,133.18 17.91,133.22 23.37,135.75 54.53,135.75 v3(58.8,131.48)
  Bottom Layer w0.254: H5.2 67.69,121.28 58.8,130.17 v3(58.8,131.48)
PRESSURESENSE: length 19.6
  Top Layer w0.254: R56.2 R57.2 79.12,110.04 79.12,112.26 77.47,113.91 77.47,115.31 76.71,116.07 H4.1 72.26,116.07 69.6,118.74 H5.3
PWM1: length 68.7
  Top Layer w0.254: 65.28,68.06 64.02,68.06 63.5,67.56 63.5,53.59 62.23,52.32 53.85,52.32 53.09,51.55 53.09,35.68 U29.4 R28.2 ; v3(61.09,80.64) 61.09,82.8 62.48,84.19 63.73,84.19 ; R50.2 R4.1
  Inner2 w0.254: R4.1 63.06,75.18 61.09,75.18 v3(61.09,80.64)
PWM2: length 52.3
  Top Layer w0.254: U29.5 R27.2 ; 39.68,64.13 R46.2 ; R25.1 39.68,67.18
  Inner1 w0.254: U29.5 56.9,35.04 44.6,47.34 44.6,51.38 42.29,52.44 42.29,54.6 43.43,55.36 43.43,59.94 R44.2 R15.1
PWM2FREEWHEELMOD: length 13.9
  Top Layer w0.254: R44.1 49.98,63.7 R44.1 ; R44.1 R46.1
  Bottom Layer w0.254: CN1.3 56.39,62.48 54.74,64.13 R44.1
PWR/ETH_1: length 7.9
  Top Layer w0.254: 10.77,88.38 R33.2
  Bottom Layer w0.254: PWR/ETH.1 6.71,87.94 R33.2
PWR/ETH_3: length 8.4
  Top Layer w0.254: 10.78,91.05 R32.2
  Bottom Layer w0.254: R32.2 4.64,91.05 PWR/ETH.3
Q2_1: length 70
  Top Layer w0.254: Q2.1 47.75,71.49 51.31,67.94 51.31,62.98 49.06,60.73 48,60.73 47.74,60.48
  Top Layer w0.4: R47.1 47.46,103.4
  Inner1 w0.254: Q2.1 47.75,75.59
  Inner1 w0.4: 47.75,75.59 46.34,77.01 46.34,103.4 ; 46.34,103.4 43.66,106.08 43.66,117.74 Q8.1 ; 46.34,103.4 R14.1
Q9_1: length 19.6
  Top Layer w0.254: 43.71,83.73 43.71,82.26 v3(43.94,82.03) ; v3(56.51,73.78) 57.4,72.89 R21.1
  Inner2 w0.254: v3(43.94,82.03) 52.2,73.78 v3(56.51,73.78)
R1_1: length 1.7
  Top Layer w0.254: R1.1 106.64,145.23 STEEROPTO.1
R3_1: length 1.7
  Top Layer w0.254: REMOTEOPTO.1 106.61,135.58 R3.1
R6_2: length 2
  Top Layer w0.254: R6.2 29.81,26.03 LED5.2
R10_2: length 2.5
  Top Layer w0.254: R10.2 20.95,87.33 21.17,87.11
R15_2: length 22.2
  Top Layer w0.254: Q2.2 45.2,74.41 45.2,66.66 44.45,65.91 44.45,62.56 45.03,61.98
  Bottom Layer w0.254: R15.2 49.98,69.65 Q2.2
R16_1: length 1.7
  Top Layer w0.254: R16.1 105.11,154.81 WORKOPTO.1
R17_2: length 2.9
  Top Layer w0.254: 62.75,146.8 60.61,146.8 LED7.2
R31_1: length 31
  Top Layer w0.254: LED1.1 4.83,50.54 R19.1 8.9,48.88 9.53,48.25 16.26,48.25 17.52,49.52 LED15.2
R48_2: length 19.4
  Top Layer w0.254: v3(53.72,74.8) 53.72,72.75 ; SPEEDPULSEOPTO.1 48.09,87.92 v3(48.13,87.88)
  Inner2 w0.254: v3(48.13,87.88) 48.13,86.86 52.2,82.8 52.2,76.45 53.72,74.92 v3(53.72,74.8)
R54_2: length 1.6
  Top Layer w0.254: 30.06,51.68 R54.2
R60_1: length 3
  Top Layer w0.254: R60.1 35.18,89.78 34.16,90.8 34.16,91.07
R60_2: length 8.5
  Top Layer w0.254: R65.1 38.43,85.44 R60.2 41.4,89.78
R61_1: length 2.1
  Top Layer w0.254: R61.1 44.32,151.88 LED4.1
R64_1: length 3.8
  Top Layer w0.254: JP2.1 93.73,123.56 94.62,124.45 94.92,124.45
R+: length 81.3
  Bottom Layer w0.254: 12.86,67.42 12.98,67.3 13.46,66.79 13.46,66.41 12.95,66.16 11.3,66.16 10.92,65.78 10.92,65.27 11.56,64.56 11.56,64.13 9.65,64.13 9.65,70.1 11.18,71.62 11.56,71.62 11.81,71.87 11.81,72.76 12.06,73.02 16.64,73.02 17.78,71.87 17.78,71.37 19.18,69.97 20.07,69.97 36.19,53.84 38.74,53.84 46.48,44.82 54.1,44.82 57.78,47.87 58.17,47.62 58.04,46.22 58.29,45.97 58.42,45.97 CN2.1
R-: length 81.3
  Bottom Layer w0.254: 15.41,63.62 12.19,63.62 9.14,63.62 9.14,70.35 10.92,72.13 11.3,72.13 11.3,73.02 11.81,73.53 16.89,73.53 18.29,72.13 18.29,71.62 19.43,70.48 20.32,70.48 36.45,54.35 39.12,54.35 46.99,45.33 53.85,45.33 55.75,46.98 57.53,48.38 60.32,48.38 61.45,47.25 61.71,47.25
REMOTEPIN: length 29.6
  Top Layer w0.254: v3(85.22,138.3) D9.1
  Inner2 w0.254: H5.1 69.47,122.93 77.47,122.93 85.22,130.68 v3(85.22,138.3)
REMOTETEENSY: length 103.6
  Top Layer w0.254: REMOTEOPTO.4 105.03,130.93 102.78,133.18 LED_REMOTE.2 94.32,133.18 92.71,131.56 v3(89.15,131.56)
  Inner1 w0.254: v3(89.15,131.56) 89.15,89.53 93.22,85.46 93.34,57.27 94.23,56.25 94.23,50.41 U30.20
RIGHT: length 47
  Top Layer w2: 45.85,113.4 U2.10
  Top Layer w3.5: J2.6 19.36,119.18 23.5,115.05
  Top Layer w4: 47.22,113.72 47.22,111.85 42.75,107.38 ; 23.5,115.05 23.5,110.1 26.22,107.38 42.75,107.38
  Bottom Layer w2: 45.85,113.4 U2.10
RJ1_5: length 18.4
  Top Layer w0.254: C12.2 26.79,68.68 28.19,68.68 C26.2
  Inner2 w0.254: 15.4,66.16 21.74,66.16 C12.2
  Bottom Layer w0.254: 15.15,66.16 14.61,66.16 13.33,64.88 RJ1.5
RJ1_9: length 24.6
  Top Layer w0.254: 19.81,68.02 R24.1
  Inner2 w0.254: 19.81,72 16.76,75.05 7.18,75.05 4.28,72.15 1.61,72.15
RTKFIX: length 110.3
  Top Layer w0.254: 17.4,82.42 12.82,82.42
  Inner1 w0.254: v3(44.2,32.5) 44.2,42.66 36.96,49.9 v3(36.96,81.53)
  Bottom Layer w0.254: v3(36.96,81.53) 32.13,81.53 30.1,83.56 18.54,83.56 17.4,82.42 ; v3(44.2,32.5) 69.38,32.5 70.87,33.99 70.87,34.9 71.63,35.67 73.42,35.67 U29.12
RX1: length 95.6
  Bottom Layer w0.254: U18.2 35.81,31.62 45.09,31.62 46.38,31.87 92.46,31.87 U29.20
RX2: length 59.6
  Bottom Layer w0.254: 10.78,32.38 12.81,30.34 28.07,30.34 29.08,29.33 32.13,29.33 36.03,33.23 65.88,33.23 U29.9
RX3: length 140.9
  Top Layer w0.254: v3(39.62,11.04) SJ2.2 SJ2.1 44.07,6.22 48.39,10.53 v3(48.39,12.82)
  Inner1 w0.254: v3(48.39,12.82) 68.33,33.14 68.33,43.3 U30.12 ; U24.2 86.09,6.61 81.66,11.04 v3(39.62,11.04)
  Bottom Layer w0.254: P2.3 93.57,17.01 86.09,9.53 U24.2
SCL0: length 47.8
  Top Layer w0.254: 89.87,69.59 89.87,68.52 88.77,67.43 83.44,67.43 69.09,53.08 67.44,53.08 64.52,50.16 U30.8 ; H14.4 96.77,63.75 JP1.1 JP1.2 91.99,69.72 R7.1 R12.2
SCL_HV: length 38.3
  Top Layer w0.254: v3(74.68,137.15) 73.93,136.41 73.93,124.4 ; P4.3 74.31,148.71 Q4.3 74.82,149.46 v3(73.53,150.74) R63.2
  Inner1 w0.254: v3(73.53,150.74) 72.9,150.11 72.9,145.92 74.68,144.14 v3(74.68,137.15)
SCL_LV: length 123.2
  Top Layer w0.254: v3(78.1,151.25) 77.02,150.17 Q4.2
  Inner1 w0.254: v3(78.1,151.25) 78.99,150.36 78.99,139.06 87,131.06 87,102.61 86.11,101.72 83.44,101.72 83.06,101.34 76.2,101.34 74.68,99.81 74.68,98.93 66.8,91.05 66.8,78.14 72.14,72.8 U30.11
SDA_HV: length 29.5
  Top Layer w0.254: P4.4 73.93,146.17 Q5.3 74.82,143.99 76.19,142.62 76.19,133.97 74.43,132.21 74.43,124.4
SDA_LV: length 119.9
  Top Layer w0.254: Q5.2 75.5,146.23 v3(74.42,147.31)
  Inner1 w0.254: U30.10 69.6,50.67 66.29,53.97 66.29,59.68 67.44,60.83 69.09,60.83 69.6,61.46 69.6,74.03 65.28,78.35 65.28,92.19 76.45,103.37 81.41,103.37 83.19,105.15 83.19,132.45 77.72,137.91 77.72,144.01 v3(74.42,147.31)
SPEED+: length 81.2
  Top Layer w0.254: R65.2 37.38,93.07 34.16,93.07 34.16,95.75 33.15,96.64 29.59,96.64 29.46,100.58 19.56,100.58 19.56,103.37 14.86,108.07 14.86,114.42 12.8,116.48 12.8,117.19
  Inner2 w0.254: J4.2 62.87,102.35 60.32,102.35 54.23,96.26 54.23,95.75 53.59,95.12 52.07,95.12 50.67,96.51 40.51,96.51 39.24,95.24 R65.2
  Bottom Layer w0.254: J4.2 SJ3.2
